# EasyEDA Pro project AgOopenHardwareMicro.eprj, schematic AiO v4 Micro Robin (continued)
## Sheets (continued)
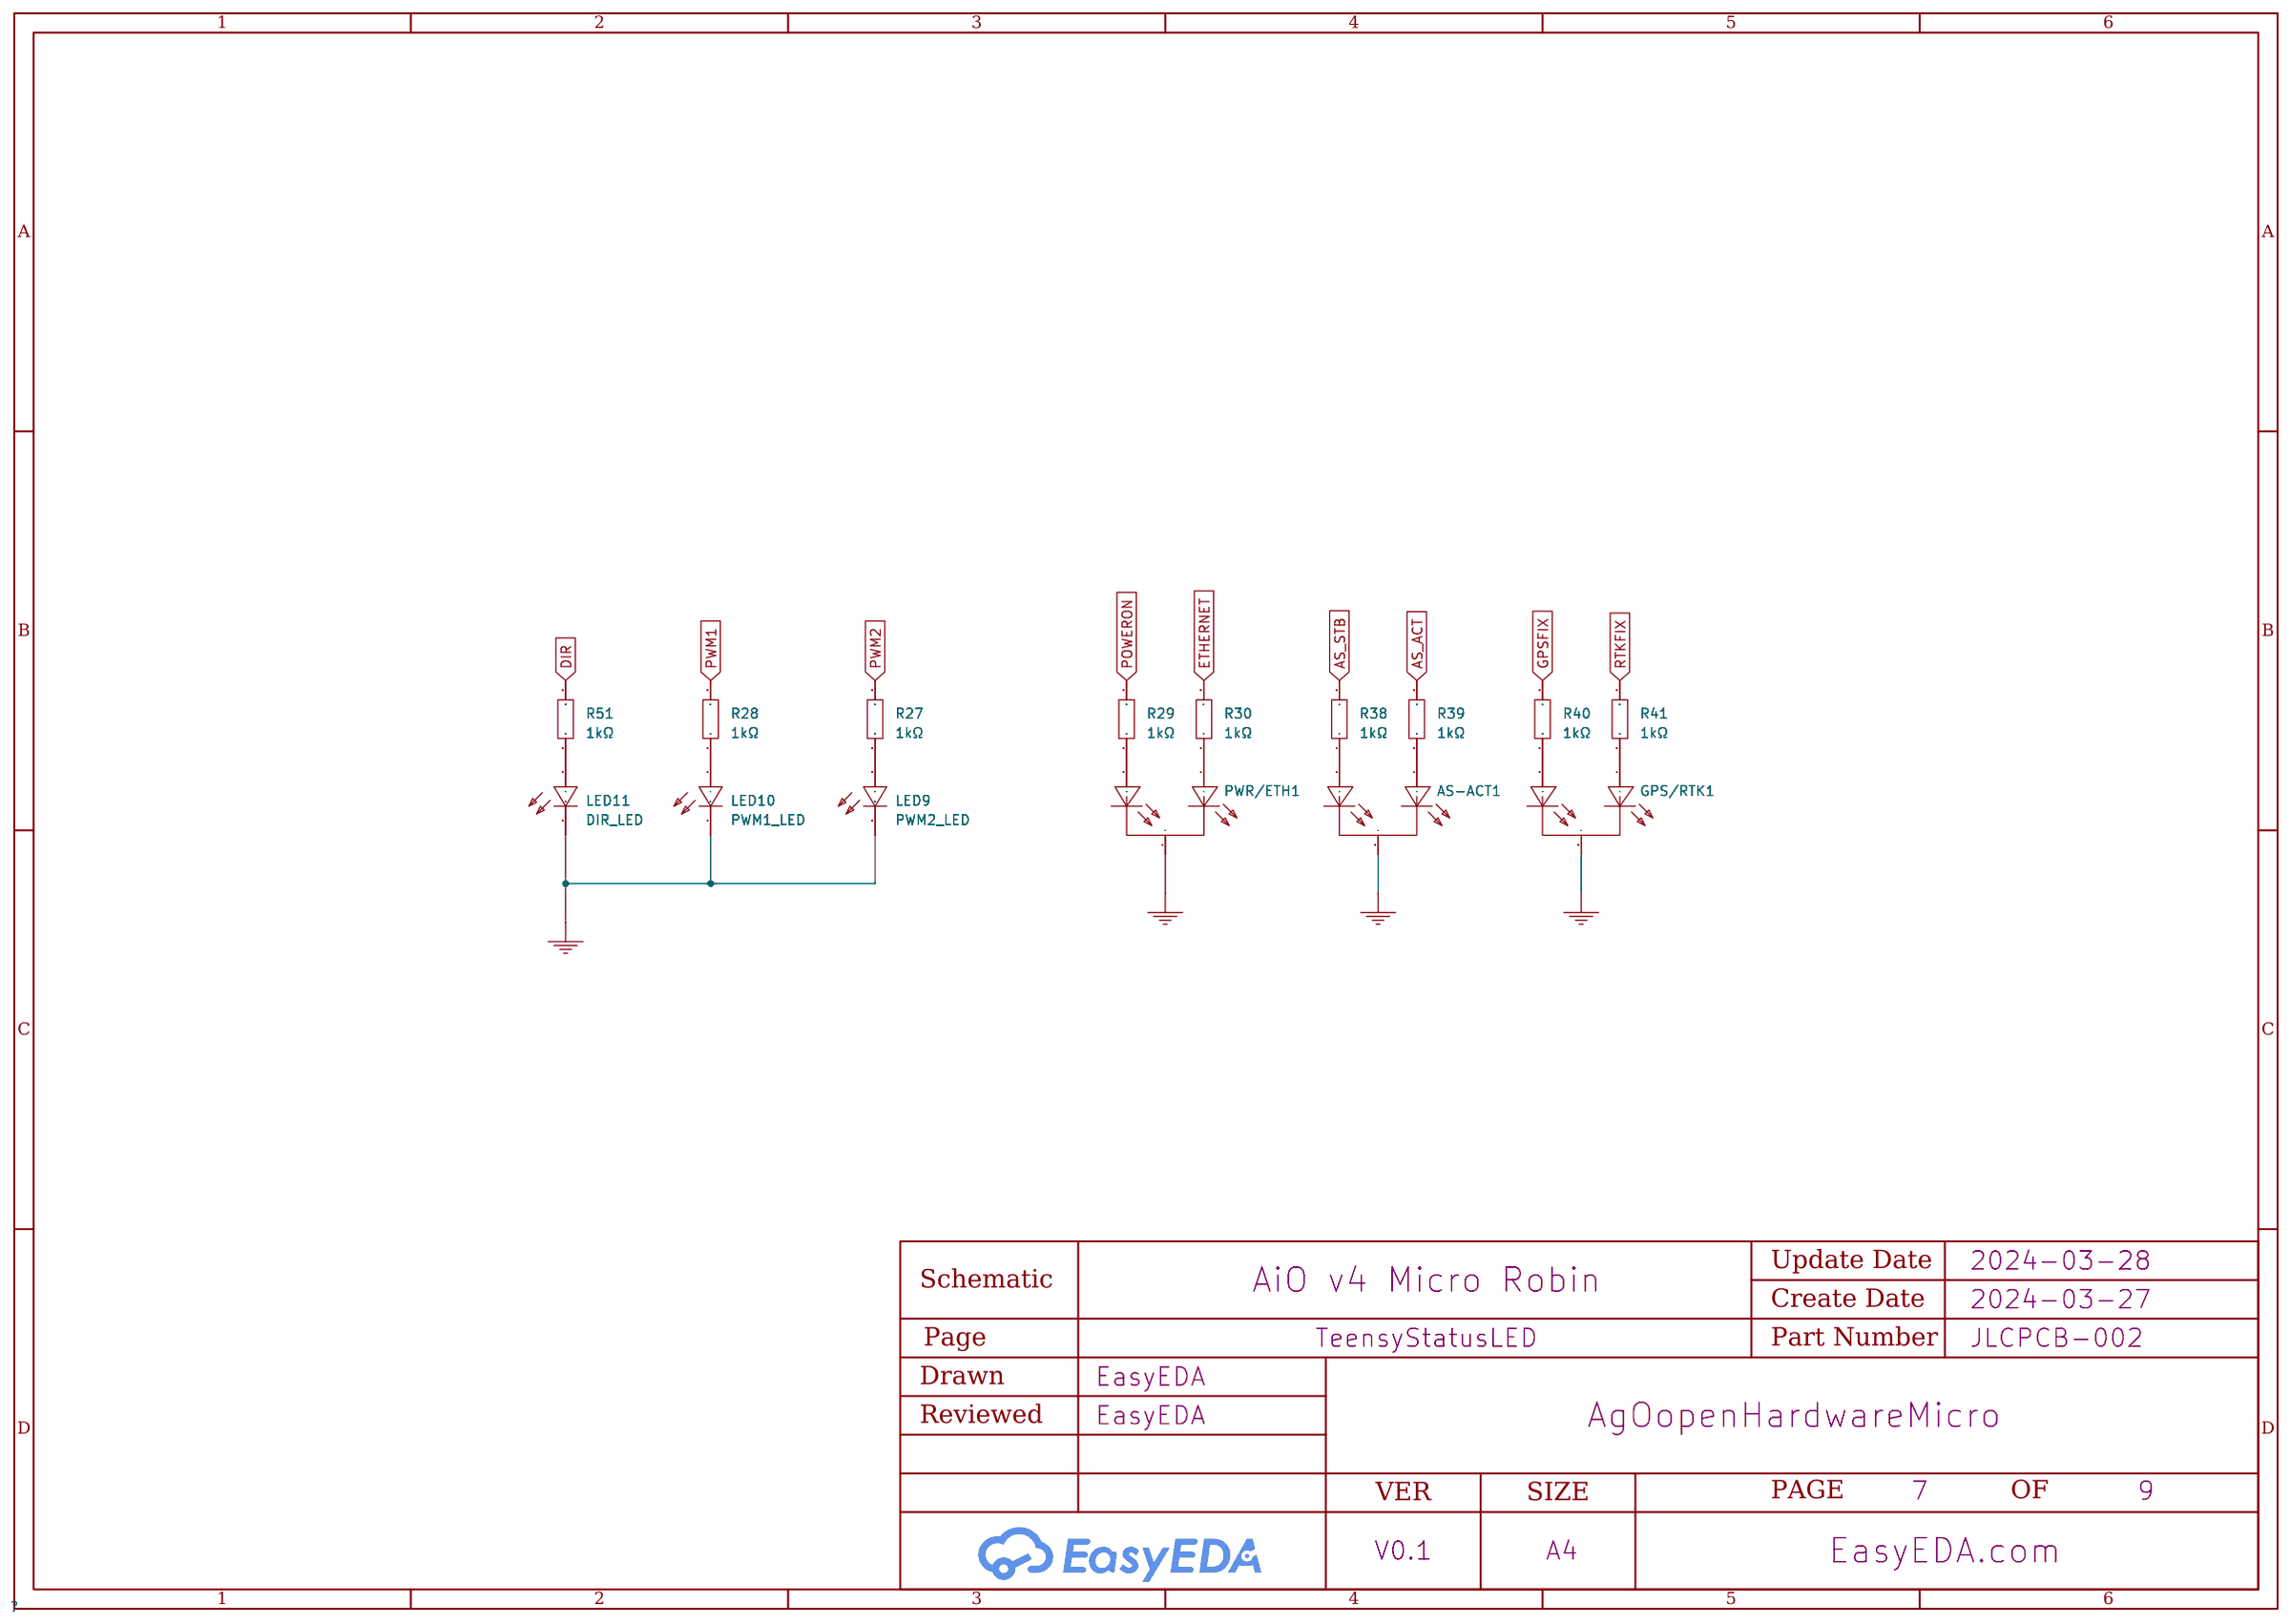
[diagram p5: TeensyStatusLED]
6 IMU: Page Name: IMU; Update Date: 2024-04-02
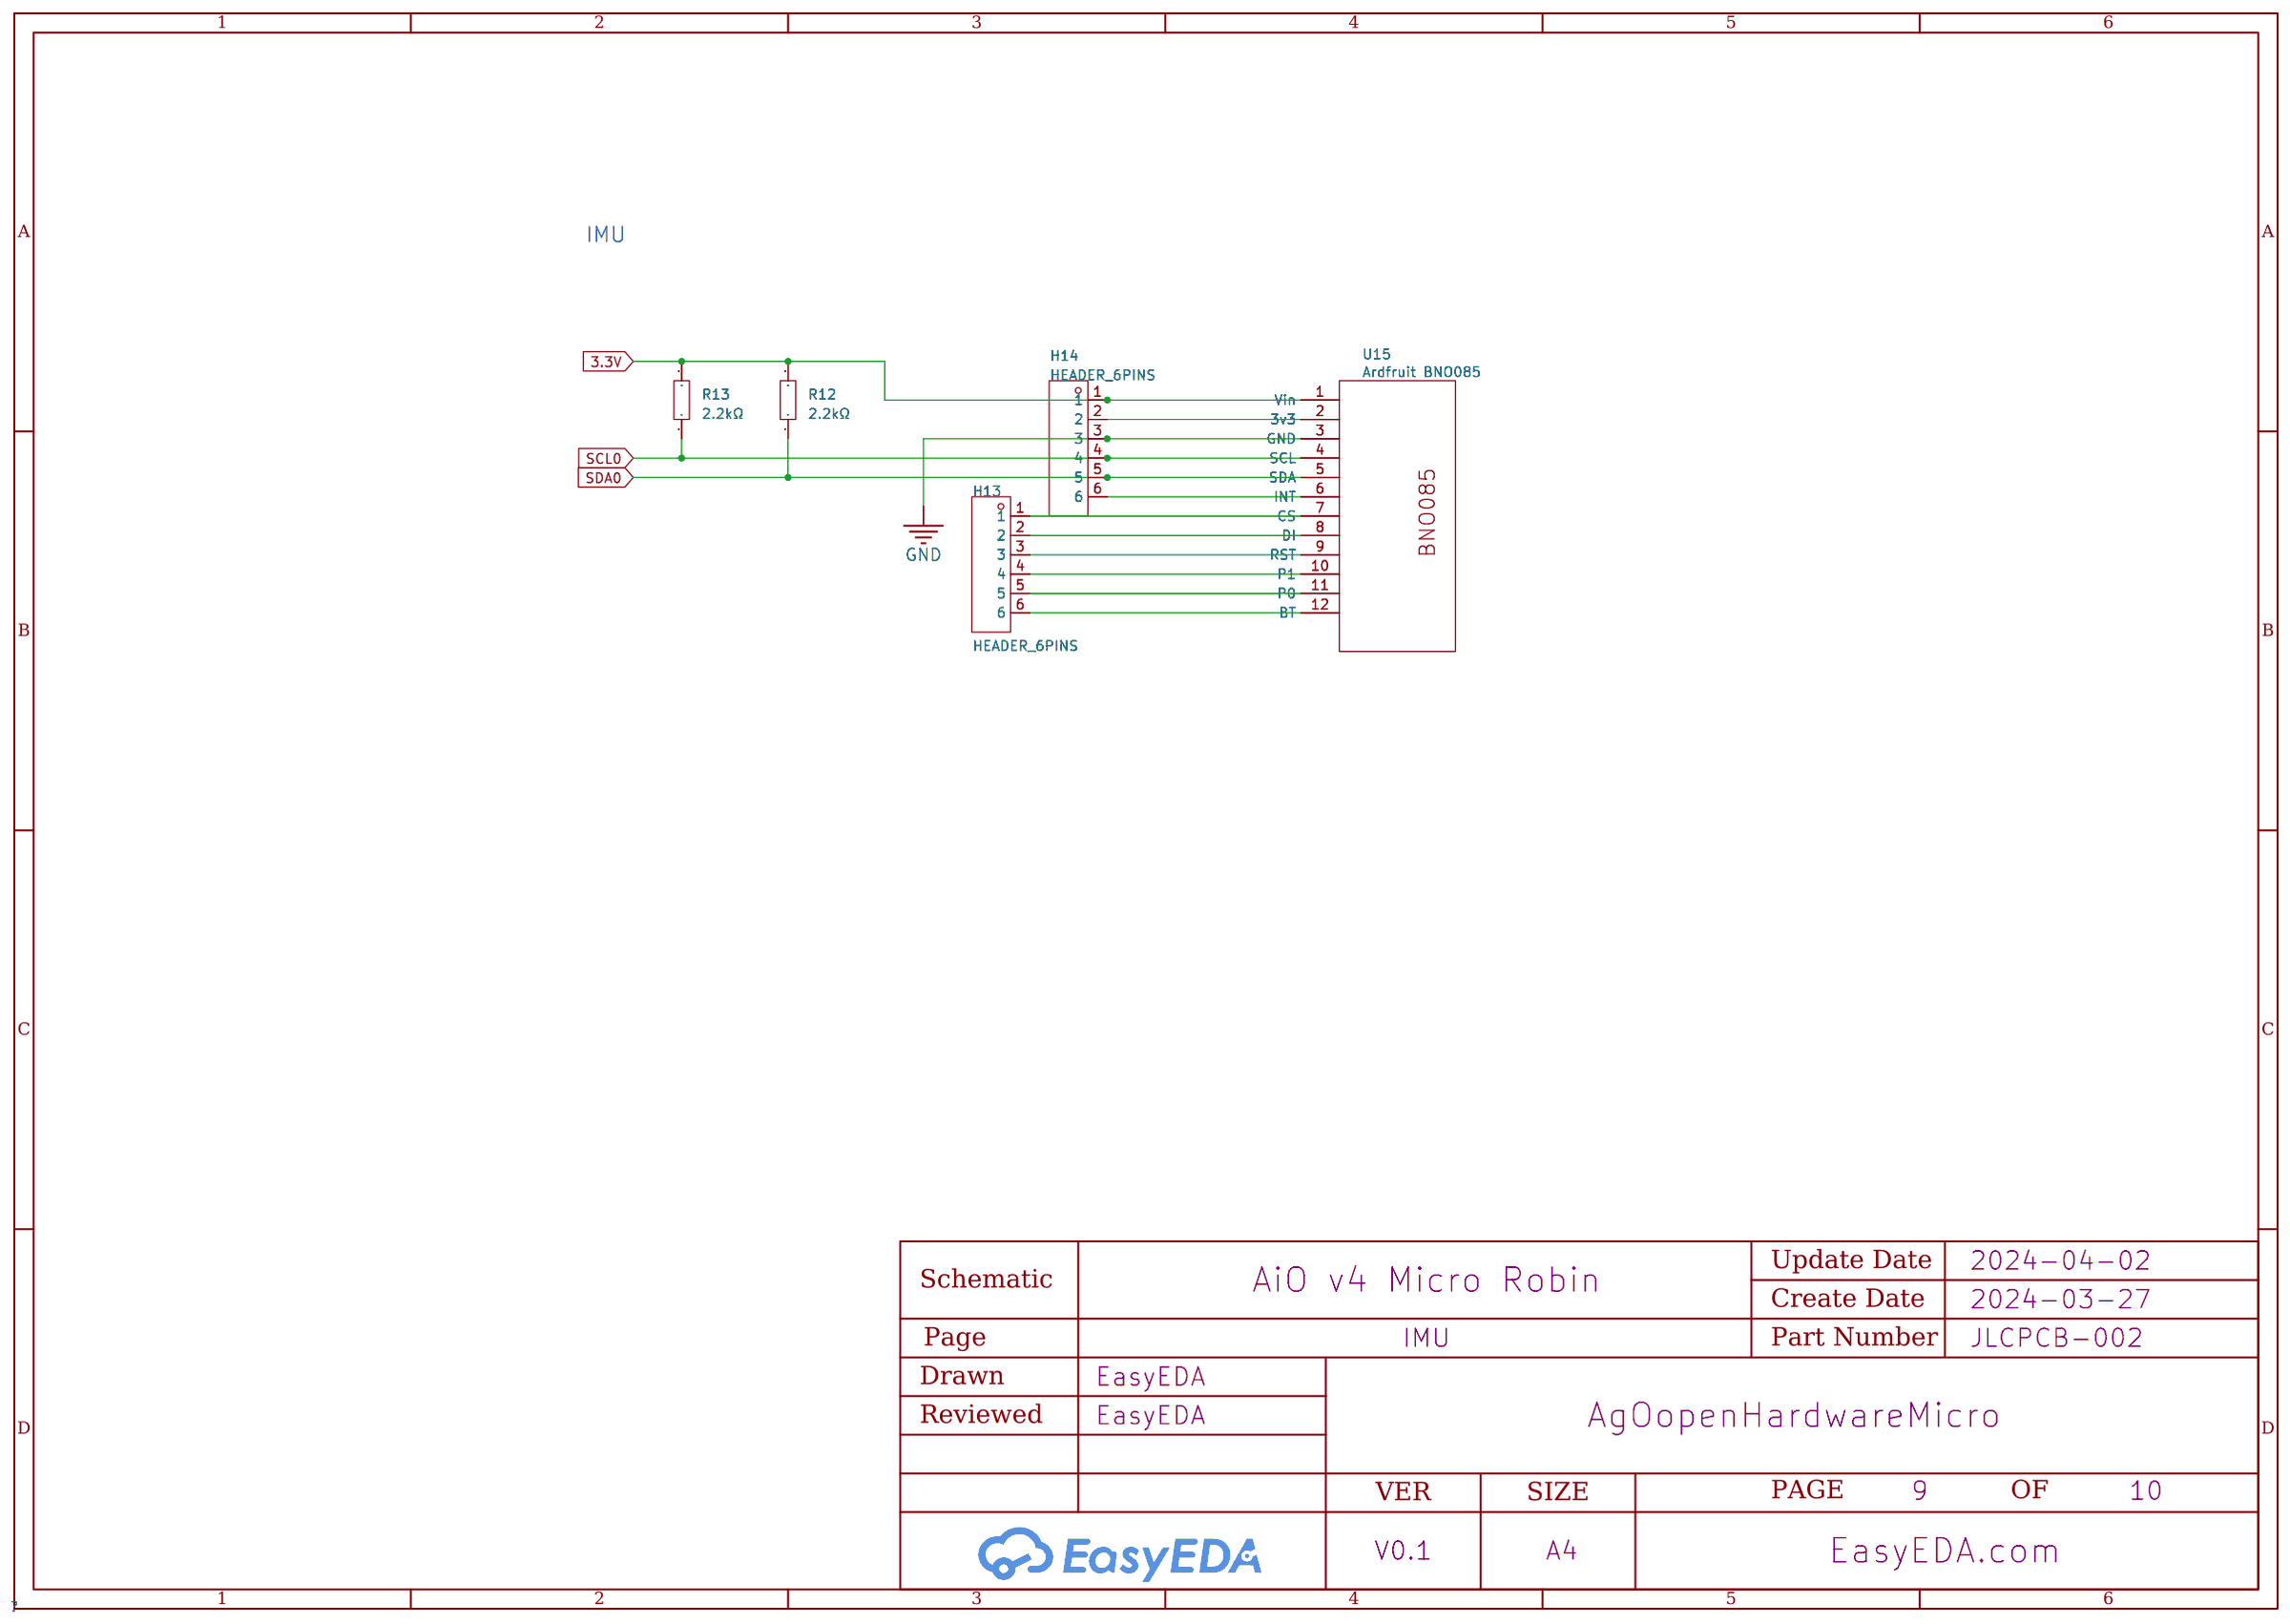
[diagram p6: IMU]
7 GNSS: Page Name: GNSS; Update Date: 2024-04-04
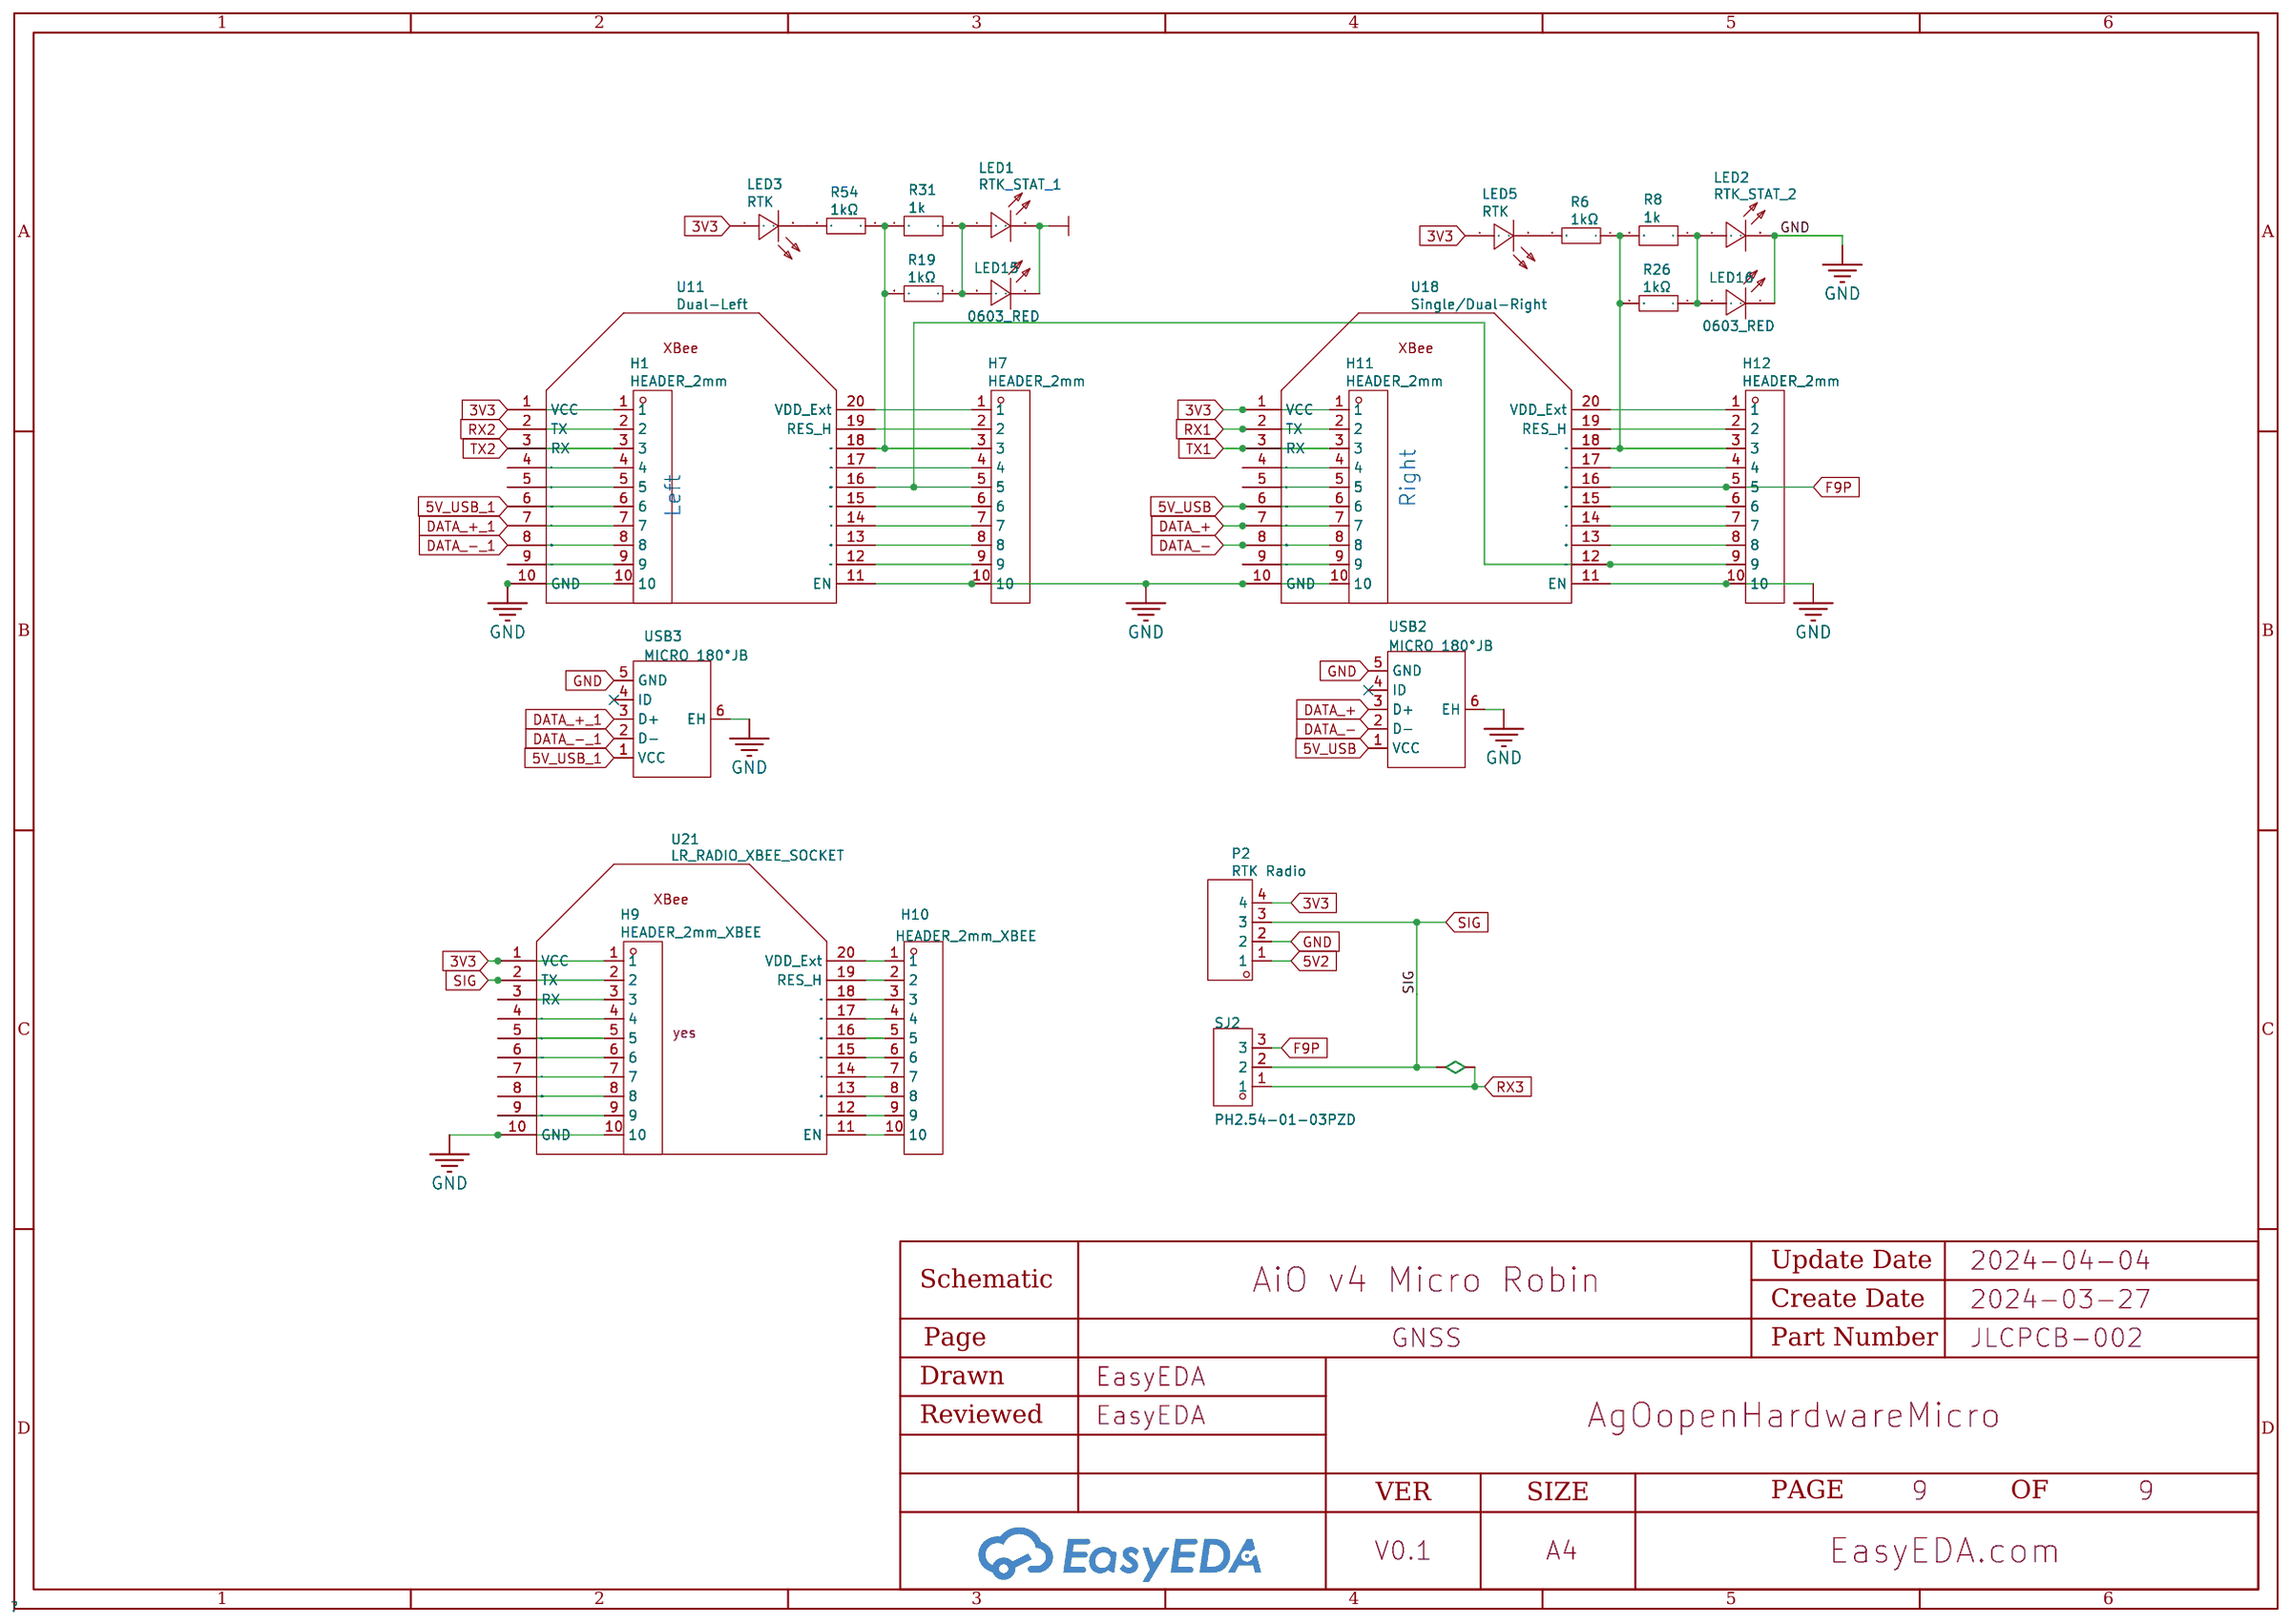
[diagram p7: GNSS]
8 TeensyCAN: Page Name: TeensyCAN; Update Date: 2024-04-04
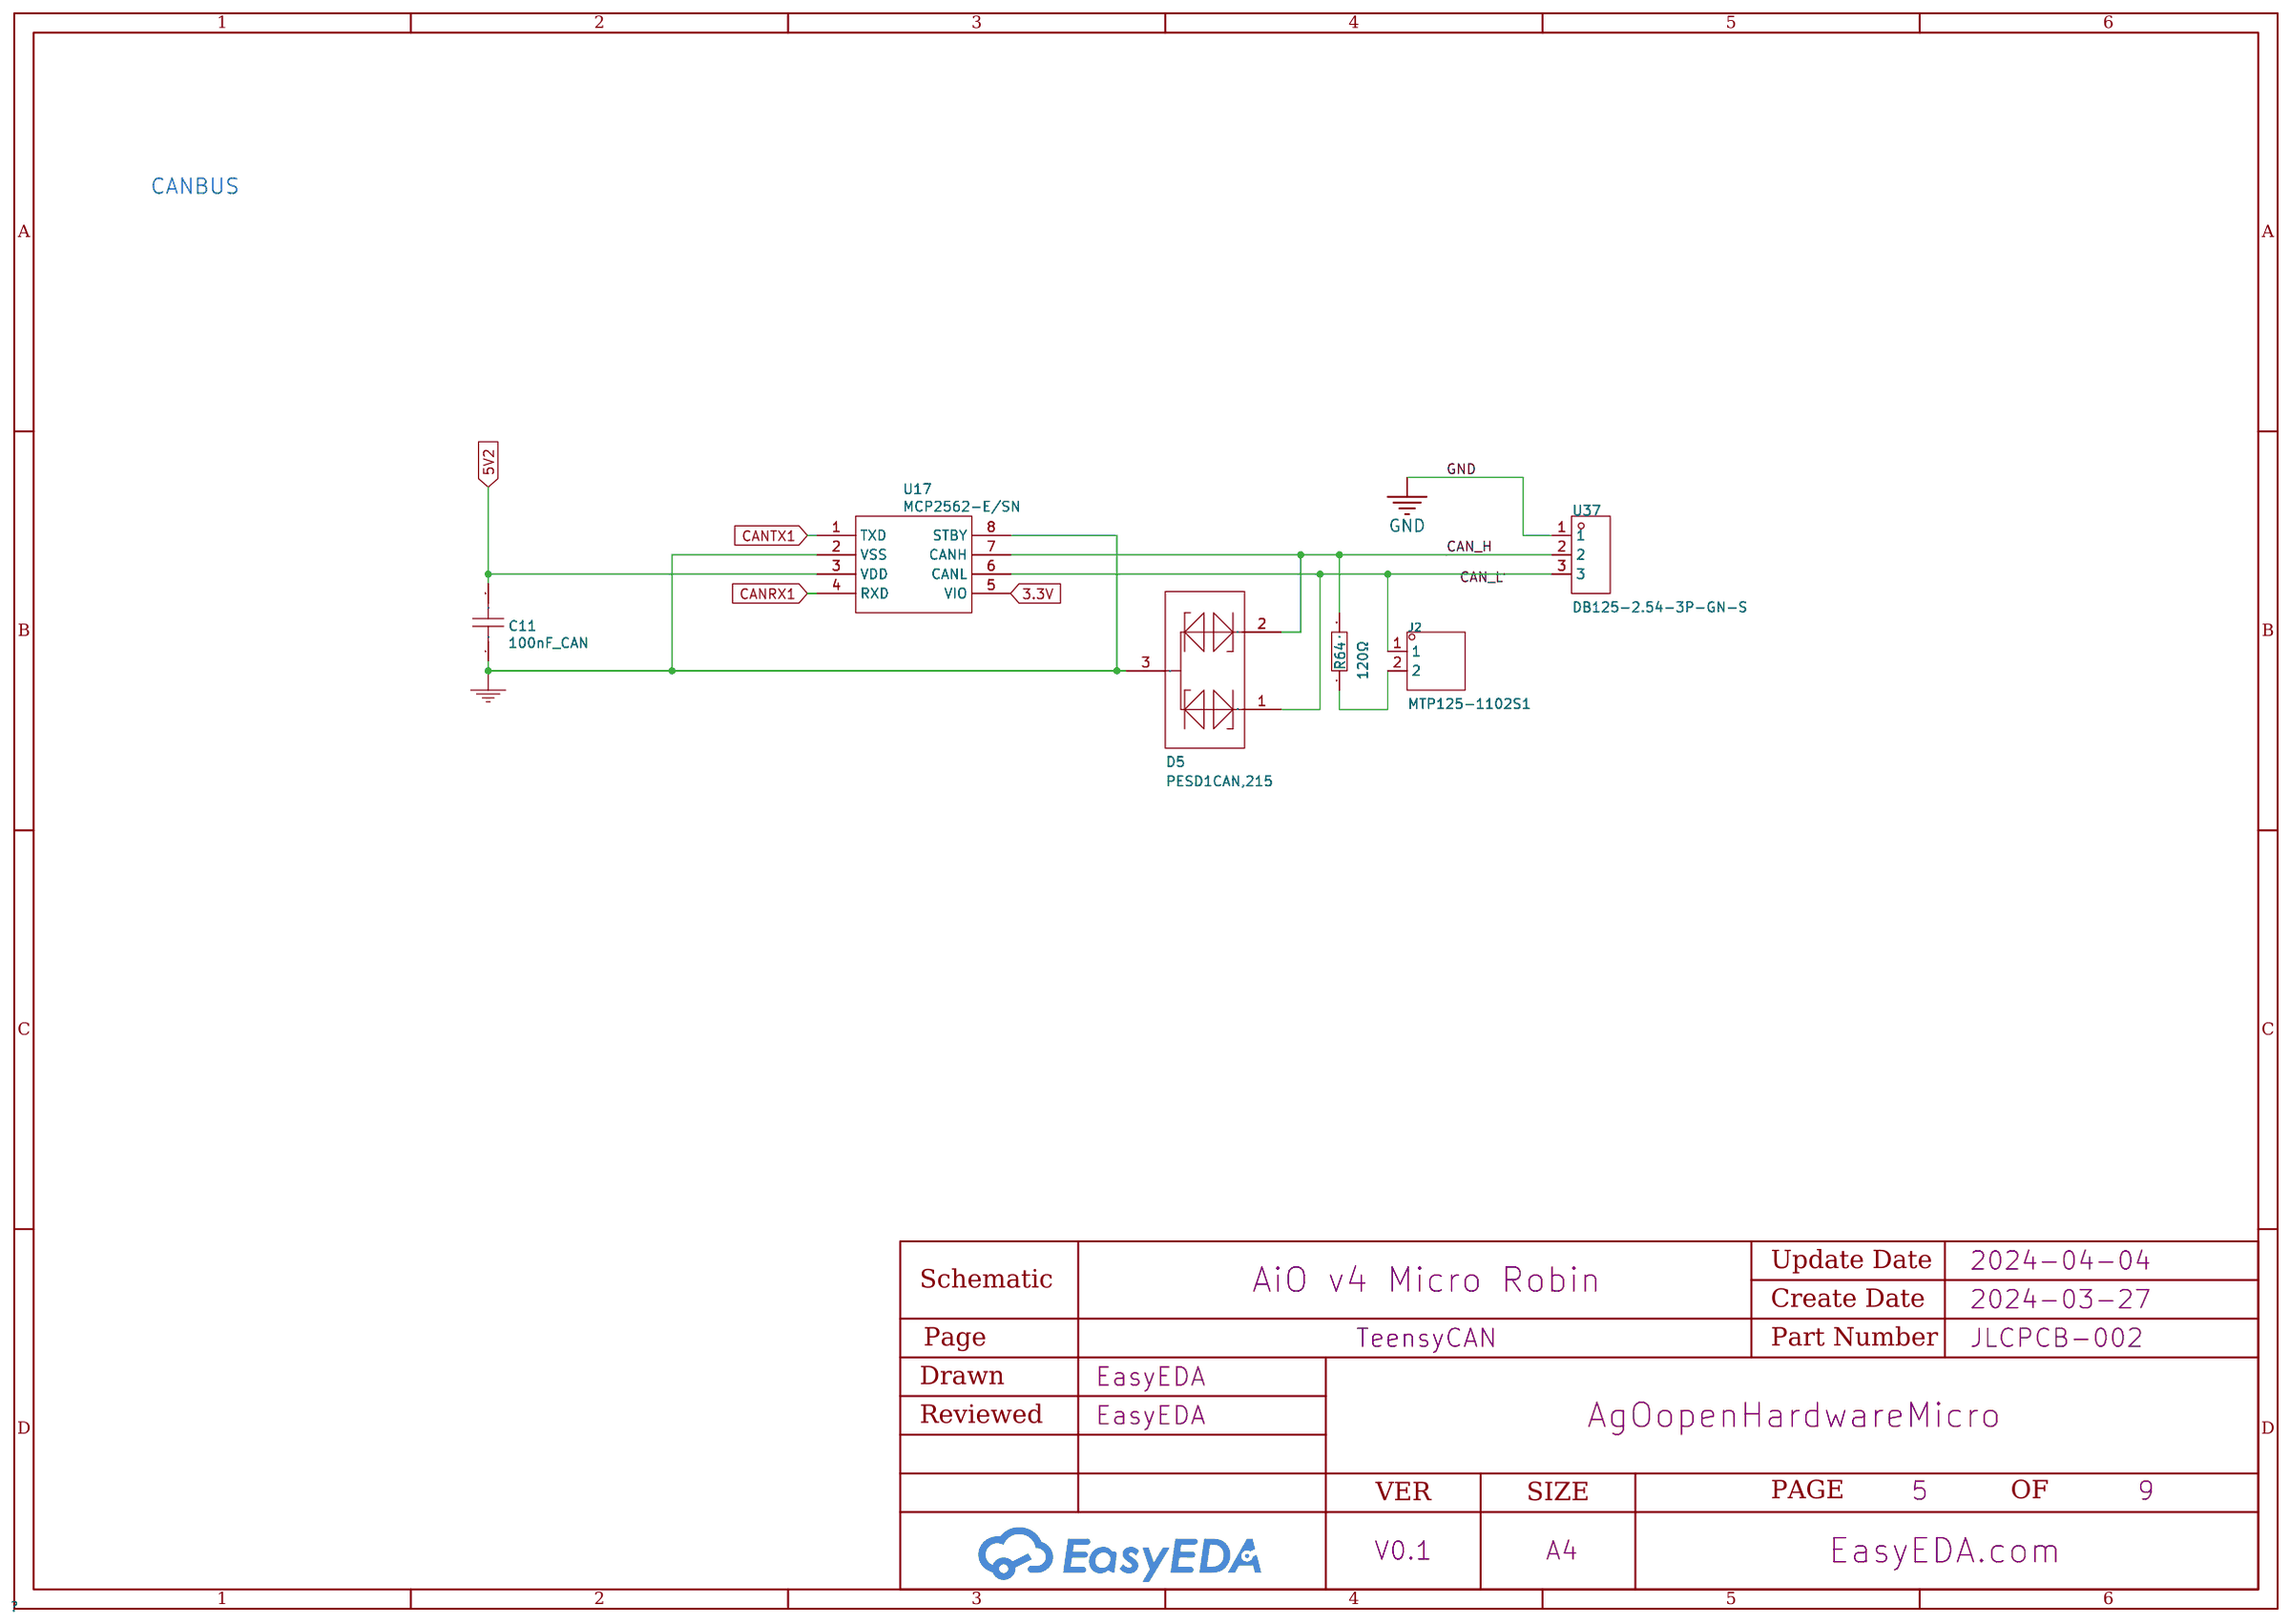
[diagram p8: TeensyCAN]
9 TeensyOutputs: Create Date: 2024-04-02; Page Name: TeensyOutputs; Update Date: 2024-04-04